# Altium schematic sheet Basic.SchDoc
size 420 x 594 mm; SheetNumber: 1; SheetTotal: 4; INDEX: СЛИЮ.687282.064 Э3; NameString3: Плата МУ2-М; NameString4: Схема электрическая; NameString5: принципиальная; Primenenie: СЛИЮ.687282.064; Razrabotal: Петров; Proveril: Бичуцкий; Utverdil: Лаврищев
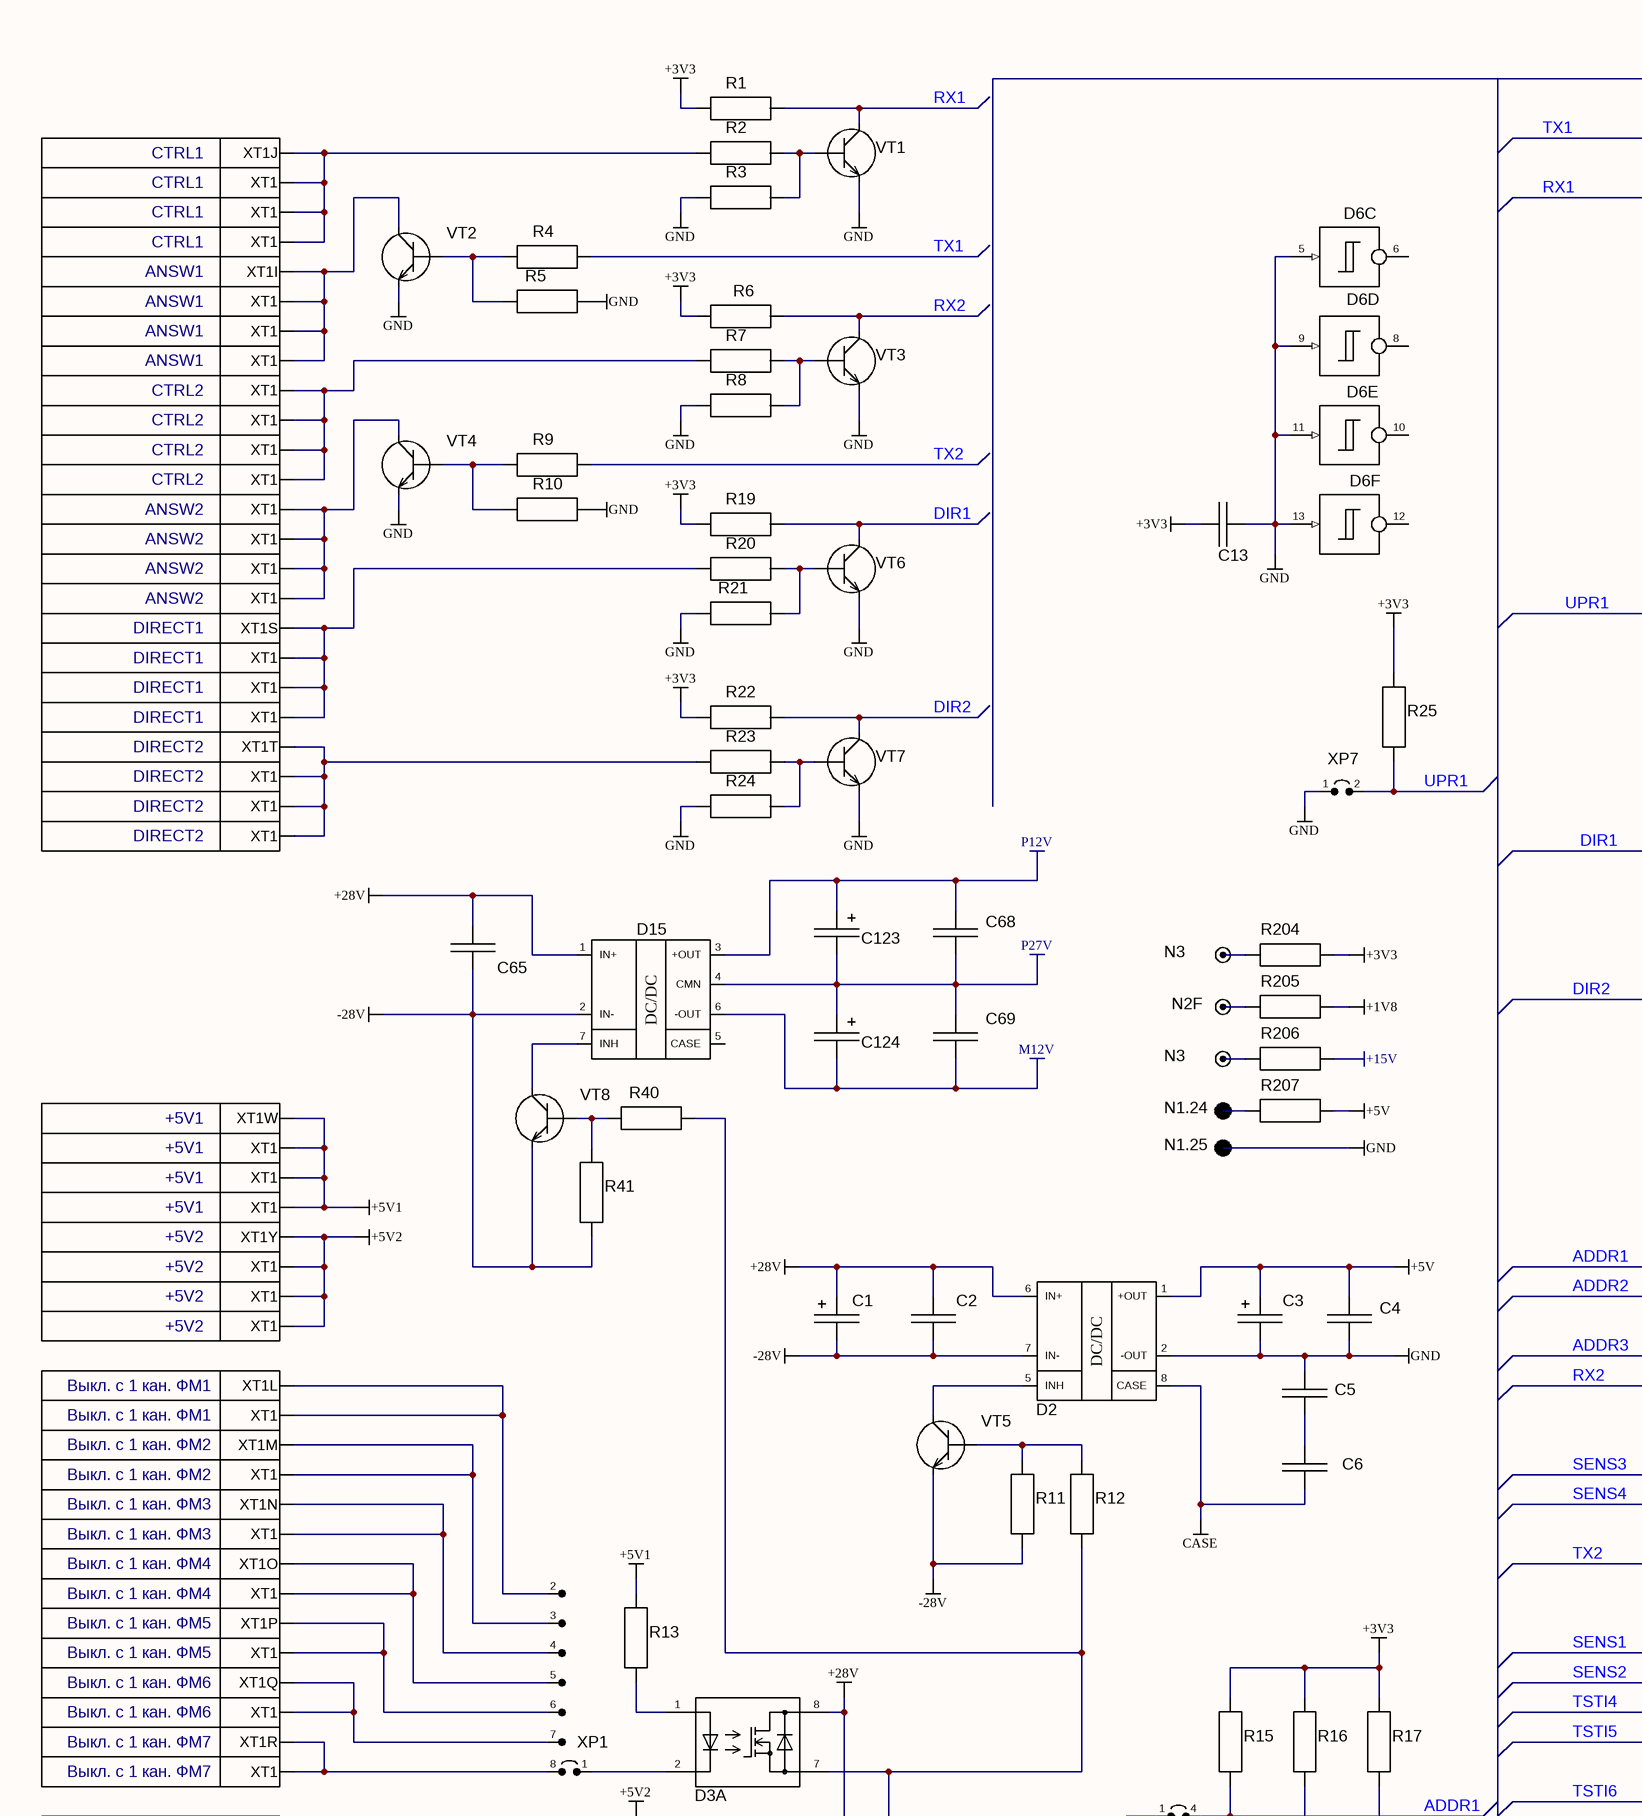
[diagram p0: Basic.SchDoc, top left]
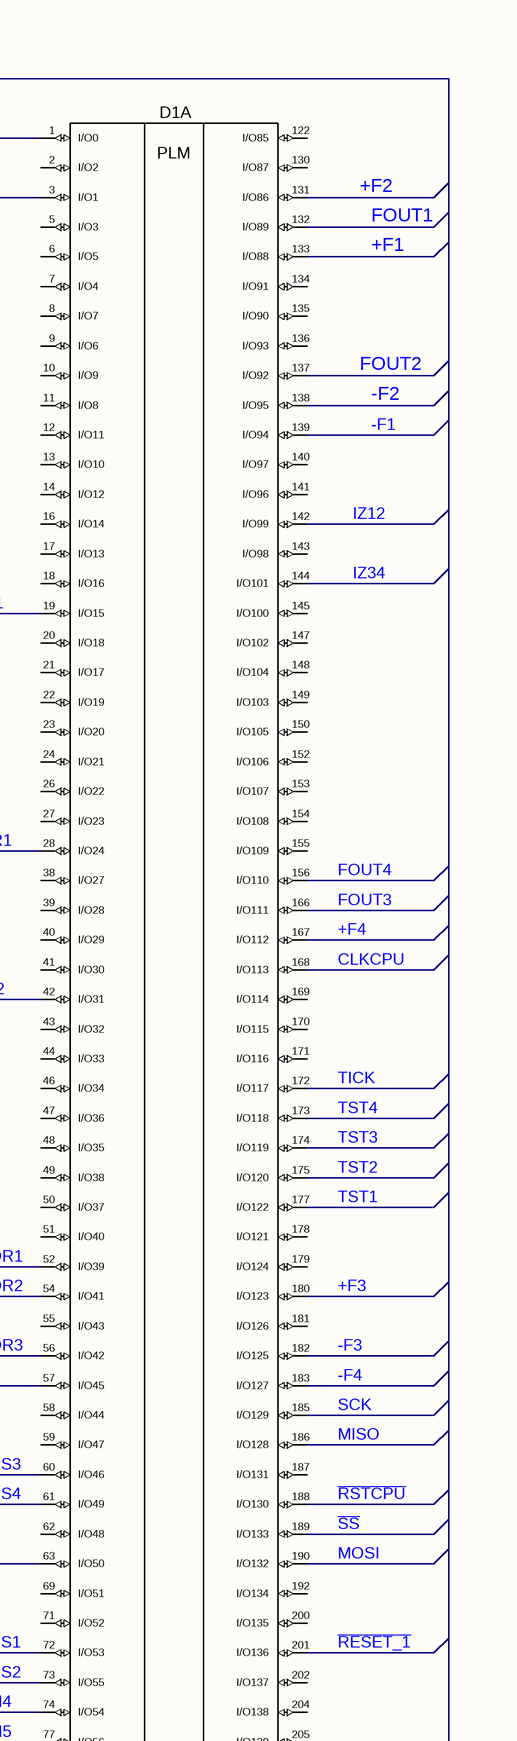
[diagram p1: Basic.SchDoc, top right]
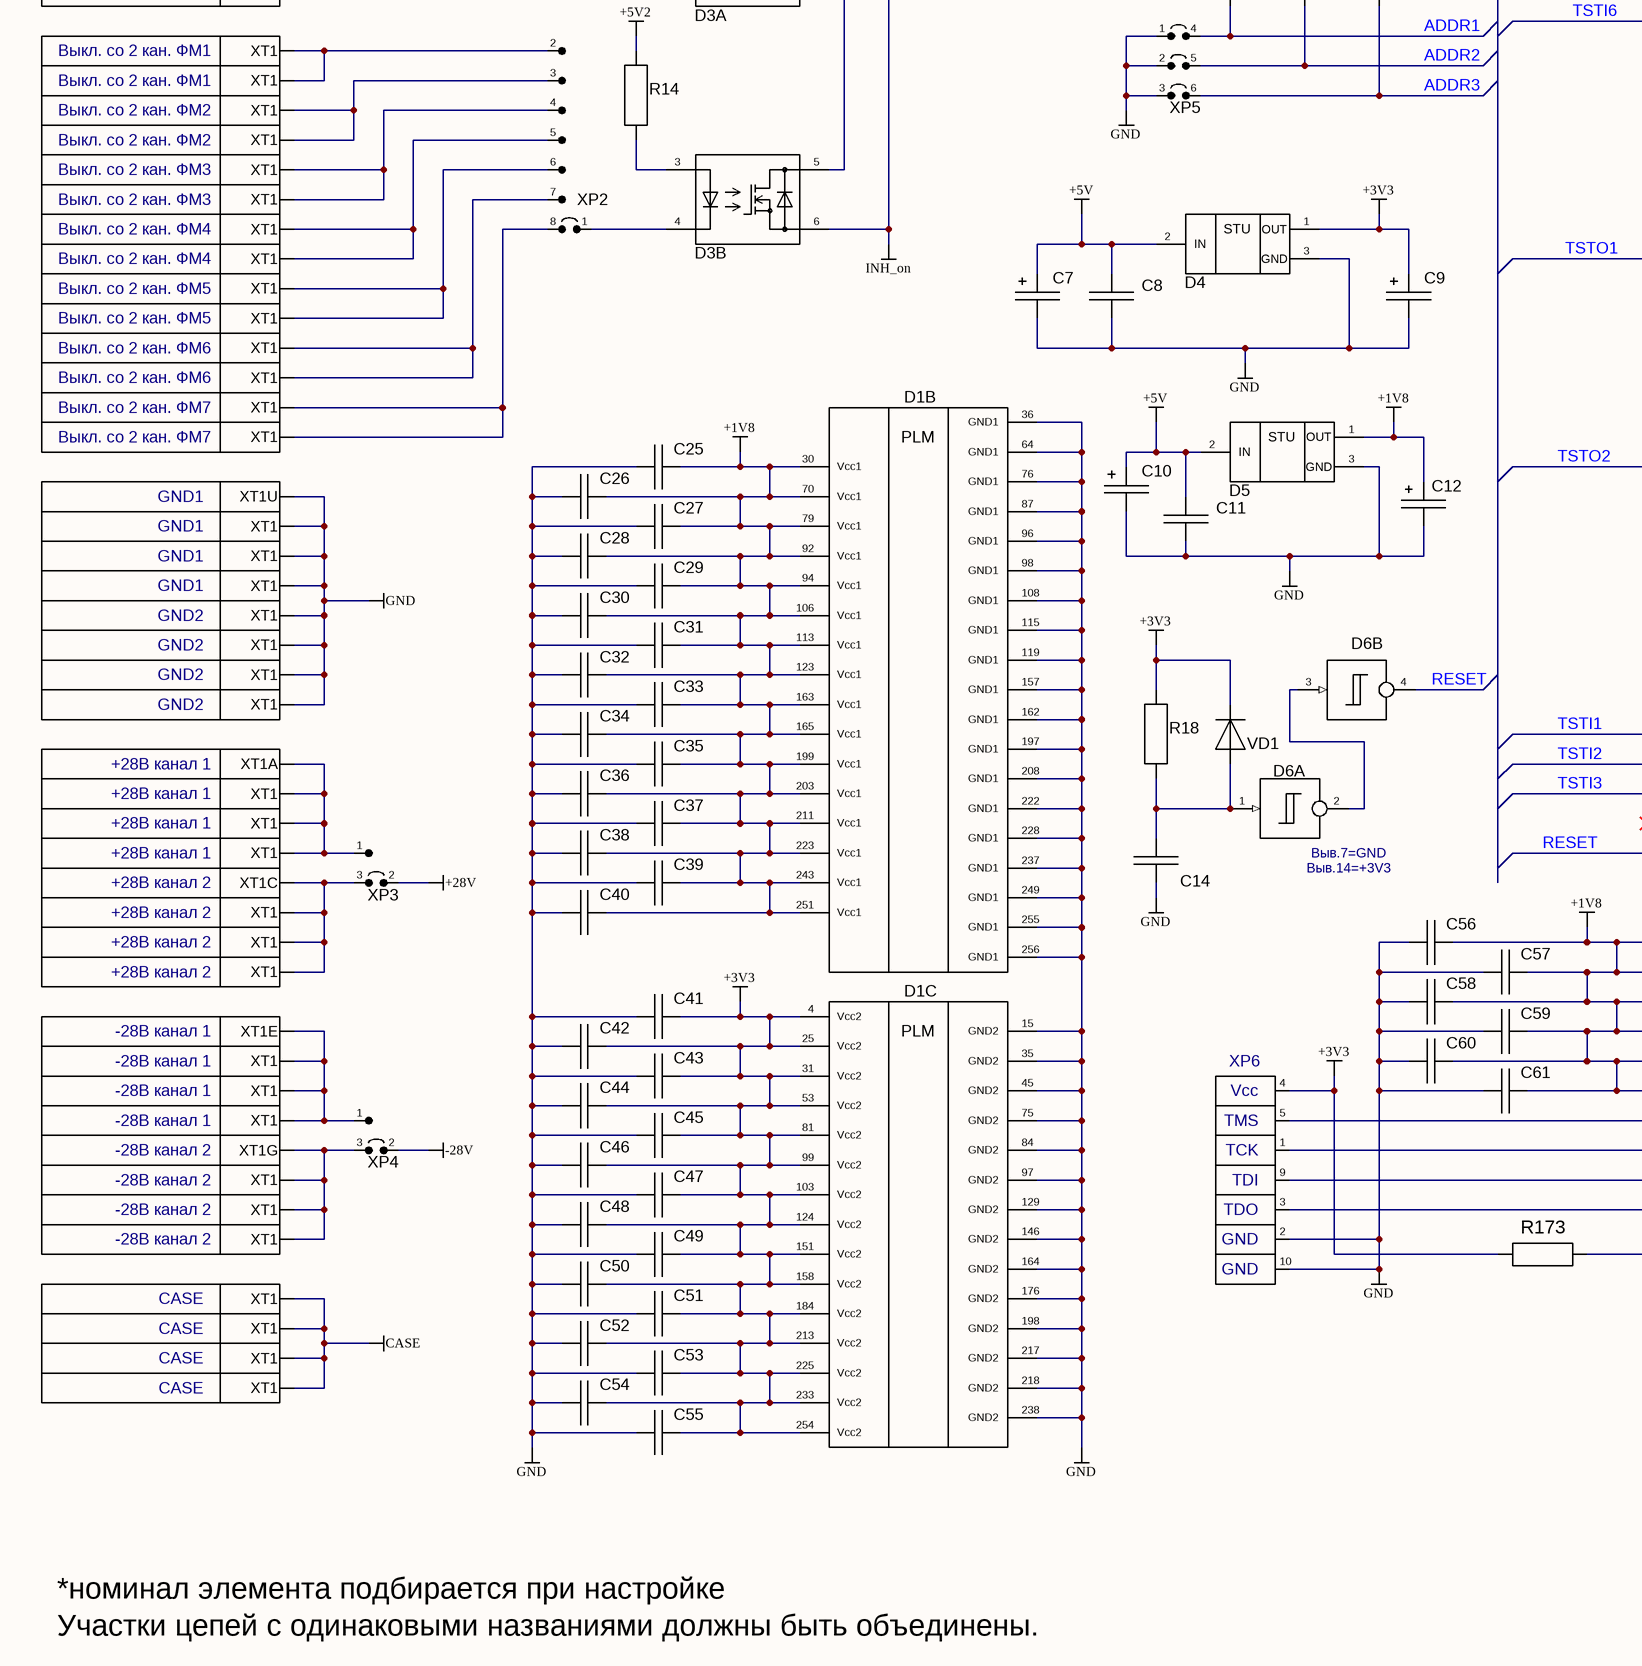
[diagram p2: Basic.SchDoc, bottom left]
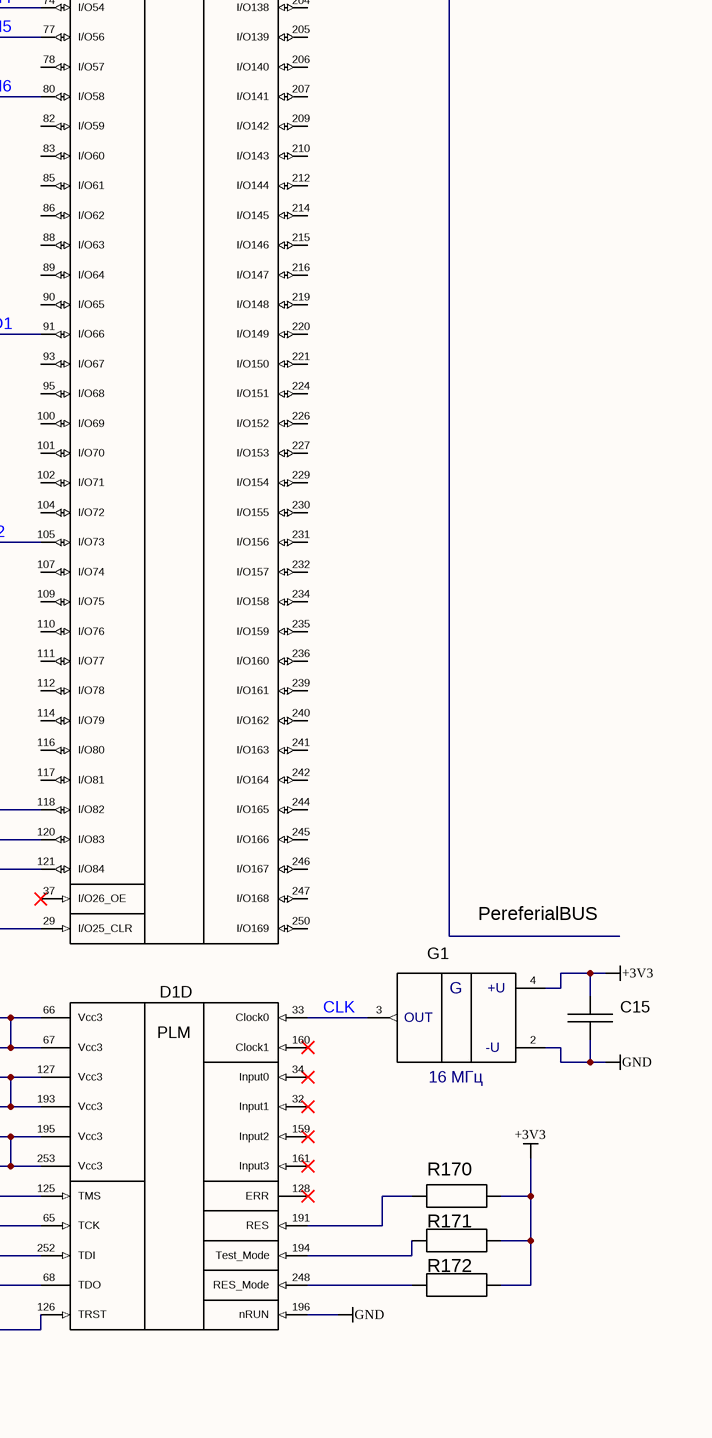
[diagram p3: Basic.SchDoc, bottom right]

## Parts
C1  (no value)  [K53_56A_TYPE4]
C2  (no value)  [K1047V_3]
C3  (no value)  [K53_56A_TYPE2]
C4  (no value)  [K1017V_5]
C5  (no value)  [K1047v_1]
C6  (no value)  [K1047v_1]
C7  (no value)  [K53_56A_TYPE2]
C8  (no value)  [K1017V_5]
C9  (no value)  [K53_56A_TYPE2]
C10  (no value)  [K53_56A_TYPE2]
C11  (no value)  [K1017V_5]
C12  (no value)  [K53_56A_TYPE2]
C13  (no value)  [K1017V_5]
C14  (no value)  [K1017V_6]
C15  (no value)  [K1017V_5]
C25  (no value)  [K1017V_4]
C26  (no value)  [K1017V_4]
C27  (no value)  [K1017V_4]
C28  (no value)  [K1017V_4]
C29  (no value)  [K1017V_4]
C30  (no value)  [K1017V_4]
C31  (no value)  [K1017V_4]
C32  (no value)  [K1017V_4]
C33  (no value)  [K1017V_4]
C34  (no value)  [K1017V_4]
C35  (no value)  [K1017V_4]
C36  (no value)  [K1017V_4]
C37  (no value)  [K1017V_4]
C38  (no value)  [K1017V_4]
C39  (no value)  [K1017V_4]
C40  (no value)  [K1017V_4]
C41  (no value)  [K1017V_4]
C42  (no value)  [K1017V_4]
C43  (no value)  [K1017V_4]
C44  (no value)  [K1017V_4]
C45  (no value)  [K1017V_4]
C46  (no value)  [K1017V_4]
C47  (no value)  [K1017V_4]
C48  (no value)  [K1017V_4]
C49  (no value)  [K1017V_4]
C50  (no value)  [K1017V_4]
C51  (no value)  [K1017V_4]
C52  (no value)  [K1017V_4]
C53  (no value)  [K1017V_4]
C54  (no value)  [K1017V_4]
C55  (no value)  [K1017V_4]
C56  (no value)  [K1017V_4]
C57  (no value)  [K1017V_4]
C58  (no value)  [K1017V_4]
C59  (no value)  [K1017V_4]
C60  (no value)  [K1017V_4]
C61  (no value)  [K1017V_4]
C65  (no value)  [K1047V_3]
C68  (no value)  [K1017V_5]
C69  (no value)  [K1017V_5]
C123  (no value)  [K53_56A_TYPE3]
C124  (no value)  [K53_56A_TYPE3]
D1  (no value)  [5576XC7Tfancort]  (parts A,B,C,D of 4)
D2  (no value)  [SMSA2805S]
D3  249KP22R  [2101_8_7M]  (value not drawn)  (parts A,B of 2)
D4  (no value)  [1325_KT_93]
D5  (no value)  [1325_KT_93]
D6  1564TL2  [401_14_5М]  (value not drawn)  (parts A,B,C,D,E,F of 6)
D15  (no value)  [SLH2800S]
G1  GK108-P-3  [GK108P]  (value not drawn)
N1.24  K  [K]  (value not drawn)
N1.25  K  [K]  (value not drawn)
N2  (no value)  [KOL26]  (part F of 26)
N3  (no value)  [KOL44]  (parts 42,44 of 44)
R1  (no value)  [R1_112_W125]
R2  (no value)  [R1_112_W125]
R3  (no value)  [R1_112_W125]
R4  (no value)  [R1_112_W125]
R5  (no value)  [R1_112_W125]
R6  (no value)  [R1_112_W125]
R7  (no value)  [R1_112_W125]
R8  (no value)  [R1_112_W125]
R9  (no value)  [R1_112_W125]
R10  (no value)  [R1_112_W125]
R11  (no value)  [R1_112_W125]
R12  (no value)  [R1_112_W125]
R13  (no value)  [R1_112_W125]
R14  (no value)  [R1_112_W125]
R15  (no value)  [R1_112_W125]
R16  (no value)  [R1_112_W125]
R17  (no value)  [R1_112_W125]
R18  (no value)  [R1_112_W125]
R19  (no value)  [R1_112_W125]
R20  (no value)  [R1_112_W125]
R21  (no value)  [R1_112_W125]
R22  (no value)  [R1_112_W125]
R23  (no value)  [R1_112_W125]
R24  (no value)  [R1_112_W125]
R25  (no value)  [R1_112_W125]
R40  (no value)  [R1_112_W125]
R41  (no value)  [R1_112_W125]
R170  (no value)  [R1_112_W125]
R171  (no value)  [R1_112_W125]
R172  (no value)  [R1_112_W125]
R173  (no value)  [R1_112_W125]
R204  (no value)  [R1_112_W125]
R205  (no value)  [R1_112_W125]
R206  (no value)  [R1_112_W125]
R207  (no value)  [R1_112_W125]
VD1  2D510A  [2D510A_P]  (value not drawn)
VT1  2T665A91  [2T665A91]  (value not drawn)
VT2  2T665A91  [2T665A91]  (value not drawn)
VT3  2T665A91  [2T665A91]  (value not drawn)
VT4  2T665A91  [2T665A91]  (value not drawn)
VT5  2T665A91  [2T665A91]  (value not drawn)
VT6  2T665A91  [2T665A91]  (value not drawn)
VT7  2T665A91  [2T665A91]  (value not drawn)
VT8  2T665A91  [2T665A91]  (value not drawn)
XP1  (no value)  [SNP346_2_8p]
XP2  (no value)  [SNP346_2_8p]
XP3  SNP346-3VP21-1  [SNP346_1_3]  (value not drawn)
XP4  SNP346-3VP21-1  [SNP346_1_3]  (value not drawn)
XP5  SNP346-6VP21-2  [SNP346_2_6]  (value not drawn)
XP6  SNP346-10VP21  [SNP346_2_10]  (value not drawn)  (parts A,B,C,D,E,I,J of 10)
XP7  (no value)  [SNP346_1_2]
XT1  SNP388-120PP21  [SNP388_120]  (value not drawn)  (parts A,C,E,G,I,J,L,M,N,O,P,Q,R,S,T,U,W,Y,27,28,29,30,31,33,35,37,39,40,42,43,44,45,46,47,48,49,50,51,53,55,57,58,59,60,61,63,65,67,69,70,72,73,74,75,76,77,78,79,80,81,83,85,87,88,89,90,91,93,95,97,99,100,102,103,104,105,106,107,108,109,110,111,113,115,117,118,119,120 of 120)

## Nets
+1V8: C12.Plus C25.2 C26.2 C27.2 C28.2 C29.2 C30.2 C31.2 C32.2 C33.2 C34.2 C35.2 C36.2 C37.2 C38.2 C39.2 C40.2 C56.2 C57.2 C58.2 C59.2 C60.2 C61.2 D1.30(Vcc1) D1.66(Vcc3) D1.67(Vcc3) D1.70(Vcc1) D1.79(Vcc1) D1.92(Vcc1) D1.94(Vcc1) D1.106(Vcc1) D1.113(Vcc1) D1.123(Vcc1) D1.127(Vcc3) D1.163(Vcc1) D1.165(Vcc1) D1.193(Vcc3) D1.195(Vcc3) D1.199(Vcc1) D1.203(Vcc1) D1.211(Vcc1) D1.223(Vcc1) D1.243(Vcc1) D1.251(Vcc1) D1.253(Vcc3) D5.1(OUT) R205.2
+3V3: C9.Plus C13.1 C15.2 C41.2 C42.2 C43.2 C44.2 C45.2 C46.2 C47.2 C48.2 C49.2 C50.2 C51.2 C52.2 C53.2 C54.2 C55.2 D1.4(Vcc2) D1.25(Vcc2) D1.31(Vcc2) D1.53(Vcc2) D1.81(Vcc2) D1.99(Vcc2) D1.103(Vcc2) D1.124(Vcc2) D1.151(Vcc2) D1.158(Vcc2) D1.184(Vcc2) D1.213(Vcc2) D1.225(Vcc2) D1.233(Vcc2) D1.254(Vcc2) D4.1(OUT) D6.14(+U) G1.4(IN+) R1.1 R6.1 R15.2 R16.2 R17.2 R18.2 R19.1 R22.1 R25.2 R170.2 R171.2 R172.2 R173.1 R204.2 VD1.Minus XP6.4
+5V: C3.Plus C4.2 C7.Plus C8.2 C10.Plus C11.2 D2.1(+OUT) D4.2(IN) D5.2(IN) R207.2
+5V1: R13.2 XT1.23 XT1.53 XT1.83 XT1.113
+5V2: R14.2 XT1.25 XT1.55 XT1.85 XT1.115
+15V: R206.2
+28V: C1.Plus C2.2 C65.2 D2.6(IN+) D3.5(OUT2+) D3.8(OUT1+) D15.1(IN+) XP3.2
-28V: C1.Minus C2.1 C65.1 D2.7(IN-) D15.2(IN-) R11.1 R41.1 VT5.E VT8.E XP4.2
CASE: C6.1 D2.8(CASE) XT1.30 XT1.60 XT1.90 XT1.120
GND: C3.Minus C4.1 C5.2 C7.Minus C8.1 C9.Minus C10.Minus C11.1 C12.Minus C13.2 C14.1 C15.1 C25.1 C26.1 C27.1 C28.1 C29.1 C30.1 C31.1 C32.1 C33.1 C34.1 C35.1 C36.1 C37.1 C38.1 C39.1 C40.1 C41.1 C42.1 C43.1 C44.1 C45.1 C46.1 C47.1 C48.1 C49.1 C50.1 C51.1 C52.1 C53.1 C54.1 C55.1 C56.1 C57.1 C58.1 C59.1 C60.1 C61.1 D1.15(GND2) D1.35(GND2) D1.36(GND1) D1.45(GND2) D1.64(GND1) D1.75(GND2) D1.76(GND1) D1.84(GND2) D1.87(GND1) D1.96(GND1) D1.97(GND2) D1.98(GND1) D1.108(GND1) D1.115(GND1) D1.119(GND1) D1.129(GND2) D1.146(GND2) D1.157(GND1) D1.162(GND1) D1.164(GND2) D1.176(GND2) D1.196(nRUN) D1.197(GND1) D1.198(GND2) D1.208(GND1) D1.217(GND2) D1.218(GND2) D1.222(GND1) D1.228(GND1) D1.237(GND1) D1.238(GND2) D1.249(GND1) D1.255(GND1) D1.256(GND1) D2.2(-OUT) D4.3(GND) D5.3(GND) D6.5(IN) D6.7(GND) D6.9(IN) D6.11(IN) D6.13(IN) G1.2(IN-) N1.25.1 R3.1 R5.2 R8.1 R10.2 R21.1 R24.1 VT1.E VT2.E VT3.E VT4.E VT6.E VT7.E XP5.1 XP5.2 XP5.3 XP6.2 XP6.10 XP7.1 XT1.21 XT1.27 XT1.51 XT1.57 XT1.81 XT1.87 XT1.111 XT1.117
INH_on: D3.6(OUT2-) D3.7(OUT1-) R12.1 R40.2
M12V: C69.1 C124.Minus D15.6(-OUT)
P12V: C68.2 C123.Plus D15.3(+OUT)
P27V: C68.1 C69.2 C123.Minus C124.Plus D15.4(CMN)
+F1: D1.133(I/O88)
+F2: D1.131(I/O86)
+F3: D1.180(I/O123)
+F4: D1.167(I/O112)
-F1: D1.139(I/O94)
-F2: D1.138(I/O95)
-F3: D1.182(I/O125)
-F4: D1.183(I/O127)
~{RESET_1}: D1.201(I/O136)
~{RSTCPU}: D1.188(I/O130)
~{SS}: D1.189(I/O133)
ADDR1: D1.52(I/O39) R15.1 XP5.4
ADDR2: D1.54(I/O41) R16.1 XP5.5
ADDR3: D1.56(I/O42) R17.1 XP5.6
CLK: D1.33(Clock0) G1.3(OUT)
CLKCPU: D1.168(I/O113)
DIR1: D1.28(I/O24) R19.2 VT6.C
DIR2: D1.42(I/O31) R22.2 VT7.C
FOUT1: D1.132(I/O89)
FOUT2: D1.137(I/O92)
FOUT3: D1.166(I/O111)
FOUT4: D1.156(I/O110)
IZ12: D1.142(I/O99)
IZ34: D1.144(I/O101)
MISO: D1.186(I/O128)
MOSI: D1.190(I/O132)
RESET: D1.29(I/O25_CLR) D6.4(OUT)
RX1: D1.3(I/O1) R1.2 VT1.C
RX2: D1.57(I/O45) R6.2 VT3.C
SCK: D1.185(I/O129)
SENS1: D1.72(I/O53)
SENS2: D1.73(I/O55)
SENS3: D1.60(I/O46)
SENS4: D1.61(I/O49)
TICK: D1.172(I/O117)
TST1: D1.177(I/O122)
TST2: D1.175(I/O120)
TST3: D1.174(I/O119)
TST4: D1.173(I/O118)
TSTI1: D1.118(I/O82)
TSTI2: D1.120(I/O83)
TSTI3: D1.121(I/O84)
TSTI4: D1.74(I/O54)
TSTI5: D1.77(I/O56)
TSTI6: D1.80(I/O58)
TSTO1: D1.91(I/O66)
TSTO2: D1.105(I/O73)
TX1: D1.1(I/O0) R4.2
TX2: D1.63(I/O50) R9.2
UPR1: D1.19(I/O15) R25.1 XP7.2
NetC5_1: C5.1 C6.2
NetC14_2: C14.2 D6.1(IN) R18.1 VD1.Plus
NetD1_65: D1.65(TCK) XP6.1
NetD1_68: D1.68(TDO) XP6.3
NetD1_125: D1.125(TMS) XP6.5
NetD1_126: D1.126(TRST) R173.2
NetD1_191: D1.191(RES) R170.1
NetD1_194: D1.194(Test_Mode) R171.1
NetD1_248: D1.248(RES_Mode) R172.1
NetD1_252: D1.252(TDI) XP6.9
NetD2_5: D2.5(INH) VT5.C
NetD3_1: D3.1 R13.1
NetD3_2: D3.2(IN1-) XP1.1
NetD3_3: D3.3(IN2+) R14.1
NetD3_4: D3.4 XP2.1
NetD6_2: D6.2(OUT) D6.3(IN)
NetD15_7: D15.7(INH) VT8.C
NetN1.24_1: N1.24.1 R207.1
NetN2_6: N2.6 R205.1
NetN3_42: N3.42 R206.1
NetN3_44: N3.44 R204.1
NetR2_1: R2.1 XT1.10 XT1.40 XT1.70 XT1.100
NetR2_2: R2.2 R3.2 VT1.B
NetR4_1: R4.1 R5.1 VT2.B
NetR7_1: R7.1 XT1.29 XT1.59 XT1.89 XT1.119
NetR7_2: R7.2 R8.2 VT3.B
NetR9_1: R9.1 R10.1 VT4.B
NetR11_2: R11.2 R12.2 VT5.B
NetR20_1: R20.1 XT1.19 XT1.49 XT1.79 XT1.109
NetR20_2: R20.2 R21.2 VT6.B
NetR23_1: R23.1 XT1.20 XT1.50 XT1.80 XT1.110
NetR23_2: R23.2 R24.2 VT7.B
NetR40_1: R40.1 R41.2 VT8.B
NetVT2_C: VT2.C XT1.9 XT1.39 XT1.69 XT1.99
NetVT4_C: VT4.C XT1.28 XT1.58 XT1.88 XT1.118
NetXP1_2: XP1.2 XT1.12 XT1.42
NetXP1_3: XP1.3 XT1.13 XT1.43
NetXP1_4: XP1.4 XT1.14 XT1.44
NetXP1_5: XP1.5 XT1.15 XT1.45
NetXP1_6: XP1.6 XT1.16 XT1.46
NetXP1_7: XP1.7 XT1.17 XT1.47
NetXP1_8: XP1.8 XT1.18 XT1.48
NetXP2_2: XP2.2 XT1.78 XT1.108
NetXP2_3: XP2.3 XT1.77 XT1.107
NetXP2_4: XP2.4 XT1.76 XT1.106
NetXP2_5: XP2.5 XT1.75 XT1.105
NetXP2_6: XP2.6 XT1.74 XT1.104
NetXP2_7: XP2.7 XT1.73 XT1.103
NetXP2_8: XP2.8 XT1.72 XT1.102
NetXP3_1: XP3.1 XT1.1 XT1.31 XT1.61 XT1.91
NetXP3_3: XP3.3 XT1.3 XT1.33 XT1.63 XT1.93
NetXP4_1: XP4.1 XT1.5 XT1.35 XT1.65 XT1.95
NetXP4_3: XP4.3 XT1.7 XT1.37 XT1.67 XT1.97

Not connected (* = marked no-connect by the designer): D1 2(I/O2) 5(I/O3) 6(I/O5) 7(I/O4) 8(I/O7) 9(I/O6) 10(I/O9) 11(I/O8) 12(I/O11) 13(I/O10) 14(I/O12) 16(I/O14) 17(I/O13) 18(I/O16) 20(I/O18) 21(I/O17) 22(I/O19) 23(I/O20) 24(I/O21) 26(I/O22) 27(I/O23) 32(Input1)* 34(Input0)* 37(I/O26_OE)* 38(I/O27) 39(I/O28) 40(I/O29) 41(I/O30) 43(I/O32) 44(I/O33) 46(I/O34) 47(I/O36) 48(I/O35) 49(I/O38) 50(I/O37) 51(I/O40) 55(I/O43) 58(I/O44) 59(I/O47) 62(I/O48) 69(I/O51) 71(I/O52) 78(I/O57) 82(I/O59) 83(I/O60) 85(I/O61) 86(I/O62) 88(I/O63) 89(I/O64) 90(I/O65) 93(I/O67) 95(I/O68) 100(I/O69) 101(I/O70) 102(I/O71) 104(I/O72) 107(I/O74) 109(I/O75) 110(I/O76) 111(I/O77) 112(I/O78) 114(I/O79) 116(I/O80) 117(I/O81) 122(I/O85) 128(ERR)* 130(I/O87) 134(I/O91) 135(I/O90) 136(I/O93) 140(I/O97) 141(I/O96) 143(I/O98) 145(I/O100) 147(I/O102) 148(I/O104) 149(I/O103) 150(I/O105) 152(I/O106) 153(I/O107) 154(I/O108) 155(I/O109) 159(Input2)* 160(Clock1)* 161(Input3)* 169(I/O114) 170(I/O115) 171(I/O116) 178(I/O121) 179(I/O124) 181(I/O126) 187(I/O131) 192(I/O134) 200(I/O135) 202(I/O137) 204(I/O138) 205(I/O139) 206(I/O140) 207(I/O141) 209(I/O142) 210(I/O143) 212(I/O144) 214(I/O145) 215(I/O146) 216(I/O147) 219(I/O148) 220(I/O149) 221(I/O150) 224(I/O151) 226(I/O152) 227(I/O153) 229(I/O154) 230(I/O155) 231(I/O156) 232(I/O157) 234(I/O158) 235(I/O159) 236(I/O160) 239(I/O161) 240(I/O162) 241(I/O163) 242(I/O164) 244(I/O165) 245(I/O166) 246(I/O167) 247(I/O168) 250(I/O169); D2 3 4; D6 6(OUT) 8(OUT) 10(OUT) 12(OUT); D15 5(CASE); G1 1; XP6 6 7 8

## Notes on the sheet
- CTRL1
- ANSW1
- CTRL2
- ANSW2
- DIRECT1
- DIRECT2
- +5V1
- +5V2
- Выкл. с 1 кан. ФМ1
- Выкл. с 1 кан. ФМ2
- Выкл. с 1 кан. ФМ3
- Выкл. с 1 кан. ФМ4
- Выкл. с 1 кан. ФМ5
- Выкл. с 1 кан. ФМ6
- Выкл. с 1 кан. ФМ7
- Выкл. со 2 кан. ФМ1
- Выкл. со 2 кан. ФМ2
- Выкл. со 2 кан. ФМ3
- Выкл. со 2 кан. ФМ4
- Выкл. со 2 кан. ФМ5
- Выкл. со 2 кан. ФМ6
- Выкл. со 2 кан. ФМ7
- GND1
- GND2
- +28В канал 1
- PereferialBUS
- +28В канал 2
- (near D6) Выв.7=GND
- Выв.14=+3V3
- -28В канал 1
- (near XP6) XP6
- (near G1) 16 МГц
- (near XP6) Vcc
- (near XP6) TMS
- -28В канал 2
- (near XP6) TCK
- (near XP6) TDI
- (near XP6) TDO
- CASE
- (near XP6) GND
- *номинал элемента подбирается при настройке
- Участки цепей с одинаковыми названиями должны быть объединены.
- Перв. примен.
- Справ. №
- Подпись и дата
- Инв.№ дубл.
- Взам. инв. №
- Лит.
- Масса
- Масштаб
- Разраб.
- Проверил
- Изм.
- Лист
- №  докум.
- Подпись
- Дата
- Инв. № подл.
- Т. контр.
- Листов
- Утвердил
- Н. Контр
- (in symbol 1325EN1_8U) STU
- (in symbol 1325EN3_3U) STU
- (in symbol 5576XC7T, part A) PLM
- (in symbol 5576XC7T, part B) PLM
- (in symbol 5576XC7T, part C) PLM
- (in symbol 5576XC7T, part D) PLM
- (in symbol GK108-P-3) G; +U; -U
- (in symbol SLH2812D_KR) DC/DC
- (in symbol SMSA28xxS) DC/DC

## Library data of the parts
C1 = K53-56-50V-3u3F±20: TYPE4; mass: 0.5; Value: 3.3 uF; ValueType: Конденсатор; ValueScreening: ОСМ; ValueName: К53-56-50В-3,3 мкФ±20%-В; ValueTechReq: АЖЯР.673546.001ТУ, П0.070.052; Part Number: K53-56-50V-3u3F±20; ComponentLink1URL: C:\AltiumLib\pdf\K53-56.pdf; ComponentLink1Description: Datasheet
C2 C65 = K10-47V-50V-0u47F: ChipCapasitor; mass: 1.5; Value: 0.47 uF; ValueType: Конденсатор; ValueScreening: ОС; ValueName: К10-47в-50В-0,47 мкФ; ValueTechReq: ОЖО.460.174ТУ, ОЖО.460.183ТУ; Part Number: K10-47V-50V-0u47F; ComponentLink1URL: C:\AltiumLib\pdf\k10-47vp.pdf; ComponentLink1Description: Datasheet
C3 C7 C9 C10 = K53-56-10V-6u8F±20: TYPE2; mass: 0.08(для варианта А=0,065); Value: 6.8 uF; ValueType: Конденсатор; ValueScreening: ОСМ; ValueName: К53-56-10В-6,8 мкФ±20%-В; ValueTechReq: АЖЯР.673546.001ТУ, П0.070.052; Part Number: K53-56-10V-6u8F±20; ComponentLink1URL: C:\AltiumLib\pdf\K53-56.pdf; ComponentLink1Description: Datasheet
C4 C8 C11 C13 C15 C68 C69 = K10-17V-N90-0u1F: K10_17V_N90_5; mass: 0.2; Value: 0.1 uF; ValueType: Конденсатор; ValueScreening: ОС; ValueName: К10-17в-Н90-0,1 мкФ; ValueTechReq: ОЖО.460.107ТУ, ОЖО.460.183ТУ; ValueDescription: TYPE5; Part Number: K10-17V-N90-0u1F; ComponentLink1URL: C:\AltiumLib\pdf\k1017v.pdf; ComponentLink1Description: Datasheet
C5 C6 = K10-47V-100V-0u01F: ChipCapasitor; mass: 0.25; Value: 0.01 uF; ValueType: Конденсатор; ValueScreening: ОС; ValueName: К10-47в-100В-0,01 мкФ; ValueTechReq: ОЖО.460.174ТУ, ОЖО.460.183ТУ; Part Number: K10-47V-100V-0u01F; ComponentLink1URL: C:\AltiumLib\pdf\k10-47vp.pdf; ComponentLink1Description: Datasheet
C12 = K53-56-6.3V-10uF±20: TYPE2; mass: 0.08(для варианта А=0,065); Value: 10 uF; ValueType: Конденсатор; ValueScreening: ОСМ; ValueName: К53-56-6,3В-10 мкФ±20%-В; ValueTechReq: АЖЯР.673546.001ТУ, П0.070.052; Part Number: K53-56-6.3V-10uF±20; ComponentLink1URL: C:\AltiumLib\pdf\K53-56.pdf; ComponentLink1Description: Datasheet
C14 = K10-17V-N90-0u47F: ChipCapasitor; mass: 0.3; Value: 0.47 uF; ValueType: Конденсатор; ValueScreening: ОС; ValueName: К10-17в-Н90-0,47 мкФ; ValueTechReq: ОЖО.460.107ТУ, ОЖО.460.183ТУ; ValueDescription: TYPE6; Part Number: K10-17V-N90-0u47F; ComponentLink1URL: C:\AltiumLib\pdf\k1017v.pdf; ComponentLink1Description: Datasheet
C25-C61 = K10-17V-N90-0u068F: ChipCapasitor; mass: 0.1; Value: 0.068 uF; ValueType: Конденсатор; ValueScreening: ОС; ValueName: К10-17в-Н90-0,068 мкФ; ValueTechReq: ОЖО.460.107ТУ, ОЖО.460.183ТУ; ValueDescription: TYPE4; Part Number: K10-17V-N90-0u068F; ComponentLink1URL: C:\AltiumLib\pdf\k1017v.pdf; ComponentLink1Description: Datasheet
C123 C124 = K53-56-20V-10uF±20: TYPE3; mass: 0.25; Value: 10 uF; ValueType: Конденсатор; ValueScreening: ОСМ; ValueName: К53-56-20В-10 мкФ±20%-В; ValueTechReq: АЖЯР.673546.001ТУ, П0.070.052; Part Number: K53-56-20V-10uF±20; ComponentLink1URL: C:\AltiumLib\pdf\K53-56.pdf; ComponentLink1Description: Datasheet
D1 = 5576XC7T: ПЛИС; ValueType: Микросхема; ValueTechReq: АЕНВ.431260.059ТУ; Ustanovka;Formovka: 35а; 44ж.3802.420.06; mass: 21g; Part Number: 5576XC7T; ComponentLink1URL: C:\AltiumLib\pdf\ИПр.pdf; ComponentLink1Description: Datasheet; ValueName: 5576XC7T; Package: 4244.256-3
D2 = SMSA28xxS: DC/DC 5W single; ValueType: Модуль питания; ValueName: SMSA2805S/KR; Mass, Prokladka: 15g,372ПЗ21.11Ю4100-82; Part Number: SMSA28xxS; ComponentLink1URL: C:\AltiumLib\pdf\smsa28.pdf; ComponentLink1Description: Datasheet
D3 = 249KP22R: 2x SS-relay; TechReq: АЕНВ.431160.047ТУ; Part Number: 249KP22R; Pakage: 2101_8_7M; ComponentLink1URL: C:\AltiumLib\pdf\Каталог ПРОТОН-2015.pdf; ComponentLink1Description: Datasheet
D4 = 1325EN3_3U: Volt reg, Iout=0.8A, Uout=3.3V; ValueType: Микросхема; ValueName: 1325ЕН3.3У; ValueTechReq: АЕЯР.431420.762-02ТУ; Mass: 0.71; Part Number: 1325EN3_3U; ComponentLink1URL: C:\AltiumLib\pdf\Military_integral2013.pdf; ComponentLink1Description: Datasheet
D5 = 1325EN1_8U: Volt reg, Iout=0.8A, Uout=1.8V; ValueType: Микросхема; ValueName: 1325ЕН1.8У; ValueTechReq: АЕЯР.431420.762-02ТУ; Mass: 0.71; Part Number: 1325EN1_8U; ComponentLink1URL: C:\AltiumLib\pdf\Military_integral2013.pdf; ComponentLink1Description: Datasheet
D6 = 1564TL2: Инв.+гист. х6; Ustanovka;Formovka: 44.3209.125.08; TechReq: бК0.347.479-07ТУ; Part Number: 1564TL2; Pakage: 401_14_5М; ComponentLink1URL: C:\AltiumLib\pdf\1564tl2.pdf; ComponentLink1Description: Datasheet
D15 = SLH2812D_KR: DC/DC 1.5W dual; ValueType: Модуль питания; ValueName: SLH2812D/KR; Mass, Prokladka: 11g, СЛИЮ.754142.219; Part Number: SLH2812D_KR; ComponentLink1URL: C:\AltiumLib\pdf\SLH_28.pdf; ComponentLink1Description: Datasheet
G1 = GK108-P-3: oscillator 3V3; TechReq: АФТП.433520.007ТУ; Part Number: GK108-P-3; ComponentLink1URL: C:\AltiumLib\pdf\ГК108-П.pdf; ComponentLink1Description: Datasheet
N2 = bSNP333-26: board analog SNP333-26; ValueType: Соединитель; ValueName: БСНП333-26; Part Number: bSNP333-26; ComponentLink1Description: Datasheet
N3 = bSNP333-44: board analog SNP333-44; ValueType: Соединитель; ValueName: БСНП333-44; Part Number: bSNP333-44; ComponentLink1Description: Datasheet
R1 R6 R11 R19 R22 R41 = R1-112-0W125-302±5: chip; Value: 3k; ValueType: Резистор; ValueName: Р1-112-0,125-3 кОм±5%-К-А; ValueTechReq: ДАРГ.434110.004ТУ; Mass: 0.006; Part Number: R1-112-0W125-302±5; ComponentLink1URL: C:\AltiumLib\pdf\ТУ_Р1-112.pdf; ComponentLink1Description: Datasheet
R2 R7 R20 R23 = R1-112-0W125-822±5: chip; Value: 8.2k; ValueType: Резистор; ValueName: Р1-112-0,125-8,2 кОм±5%-К-А; ValueTechReq: ДАРГ.434110.004ТУ; Mass: 0.006; Part Number: R1-112-0W125-822±5; ComponentLink1URL: C:\AltiumLib\pdf\ТУ_Р1-112.pdf; ComponentLink1Description: Datasheet
R3 R5 R8 R10 R21 R24 = R1-112-0W125-102±5: chip; Value: 1k; ValueType: Резистор; ValueName: Р1-112-0,125-1 кОм±5%-К-А; ValueTechReq: ДАРГ.434110.004ТУ; Mass: 0.006; Part Number: R1-112-0W125-102±5; ComponentLink1URL: C:\AltiumLib\pdf\ТУ_Р1-112.pdf; ComponentLink1Description: Datasheet
R4 R9 = R1-112-0W125-512±5: chip; Value: 5.1k; ValueType: Резистор; ValueName: Р1-112-0,125-5,1 кОм±5%-К-А; ValueTechReq: ДАРГ.434110.004ТУ; Mass: 0.006; Part Number: R1-112-0W125-512±5; ComponentLink1URL: C:\AltiumLib\pdf\ТУ_Р1-112.pdf; ComponentLink1Description: Datasheet
R12 R40 = R1-112-0W125-273±5: chip; Value: 27k; ValueType: Резистор; ValueName: Р1-112-0,125-27 кОм±5%-К-А; ValueTechReq: ДАРГ.434110.004ТУ; Mass: 0.006; Part Number: R1-112-0W125-273±5; ComponentLink1URL: C:\AltiumLib\pdf\ТУ_Р1-112.pdf; ComponentLink1Description: Datasheet
R13 R14 R204 R205 R207 = R1-112-0W125-561±5: chip; Value: 560; ValueType: Резистор; ValueName: Р1-112-0,125-560 Ом±5%-К-А; ValueTechReq: ДАРГ.434110.004ТУ; Mass: 0.006; Part Number: R1-112-0W125-561±5; ComponentLink1URL: C:\AltiumLib\pdf\ТУ_Р1-112.pdf; ComponentLink1Description: Datasheet
R15-R17 R25 = R1-112-0W125-103±5: chip; Value: 10k; ValueType: Резистор; ValueName: Р1-112-0,125-10 кОм±5%-К-А; ValueTechReq: ДАРГ.434110.004ТУ; Mass: 0.006; Part Number: R1-112-0W125-103±5; ComponentLink1URL: C:\AltiumLib\pdf\ТУ_Р1-112.pdf; ComponentLink1Description: Datasheet
R18 = R1-112-0W125-563±5: chip; Value: 56k; ValueType: Резистор; ValueName: Р1-112-0,125-56 кОм±5%-К-А; ValueTechReq: ДАРГ.434110.004ТУ; Mass: 0.006; Part Number: R1-112-0W125-563±5; ComponentLink1URL: C:\AltiumLib\pdf\ТУ_Р1-112.pdf; ComponentLink1Description: Datasheet
R170-R173 = R1-112-0W125-103±5: chip; ValueType: Резистор; ValueName: Р1-112-0,125-10 кОм±5%-К-А; ValueTechReq: ДАРГ.434110.004ТУ; Mass: 0.006; Value: 10k; Part Number: R1-112-0W125-103±5; ComponentLink1URL: C:\AltiumLib\pdf\ТУ_Р1-112.pdf; ComponentLink1Description: Datasheet
R206 = R1-112-0W125-202±5: chip; Value: 2k; ValueType: Резистор; ValueName: Р1-112-0,125-2 кОм±5%-К-А; ValueTechReq: ДАРГ.434110.004ТУ; Mass: 0.006; Part Number: R1-112-0W125-202±5; ComponentLink1URL: C:\AltiumLib\pdf\ТУ_Р1-112.pdf; ComponentLink1Description: Datasheet
VD1 = 2D510A: диод; TechReq: АЕЯР.432120.602ТУ; Ustanovka;Formovka: 3;25.2018.145.07; Part Number: 2D510A; ComponentLink1URL: C:\AltiumLib\pdf\Каталог интеграл.pdf; ComponentLink1Description: Datasheet
VT1-VT8 = 2T665A91: n-p-n; TechReq: АЕЯР.432140.561ТУ; Part Number: 2T665A91; ComponentLink1Description: Datasheet
XP1 XP2 = SNP346-8VP21-1: PLS-8; ValueType: Соединитель; ValueName: СНП346-8ВП21-1; ValueTechReq: РЮМК.340420.011ТУ; mass: 0.06; Part Number: SNP346-8VP21-1; ComponentLink1URL: C:\AltiumLib\pdf\СНП346.pdf; ComponentLink1Description: Datasheet
XP3 XP4 = SNP346-3VP21-1: PLS-3; TechReq: РЮМК.340420.011ТУ; Part Number: SNP346-3VP21-1; ComponentLink1URL: C:\AltiumLib\pdf\СНП346.pdf; ComponentLink1Description: Datasheet
XP5 = SNP346-6VP21-2: PLD-6; TechReq: РЮМК.340420.011ТУ; Part Number: SNP346-6VP21-2; ComponentLink1URL: C:\AltiumLib\pdf\СНП346.pdf; ComponentLink1Description: Datasheet
XP6 = SNP346-10VP21-2: PLD-10 for JTAG; TechReq: РЮМК.340420.011ТУ; Part Number: SNP346-10VP21-2; ComponentLink1URL: C:\AltiumLib\pdf\СНП346.pdf; ComponentLink1Description: Datasheet
XP7 = SNP346-2VP21-1: PLS-2; ValueType: Соединитель; ValueName: СНП346-2ВП21-1; ValueTechReq: РЮМК.340420.011ТУ; mass: 0.06; Part Number: SNP346-2VP21-1; ComponentLink1URL: C:\AltiumLib\pdf\СНП346.pdf; ComponentLink1Description: Datasheet
XT1 = SNP388-120PP21: PC-104 120 pin; TechReq: ПКНС.430421.005ТУ; Part Number: SNP388-120PP21; ComponentLink1URL: C:\AltiumLib\pdf\СНП346.pdf; ComponentLink1Description: Datasheet
N1.24 N1.25 = K: Part Number: K; ComponentLink1Description: Datasheet